# EasyEDA Pro project AgOopenHardwareMicro.eprj, schematic AiO v4 Micro Robin

## Sheets
1 Power: Create Date: 2024-03-27; Page Name: Power; Project Name: AgOopenHardwareMicro; Schematic Name: AiO v4 Micro Robin; Update Date: 2024-06-02; Company: EasyEDA.com; Drawn: EasyEDA; Page Size: A4; Part Number: JLCPCB-002; Reviewed: EasyEDA; Version: V0.1
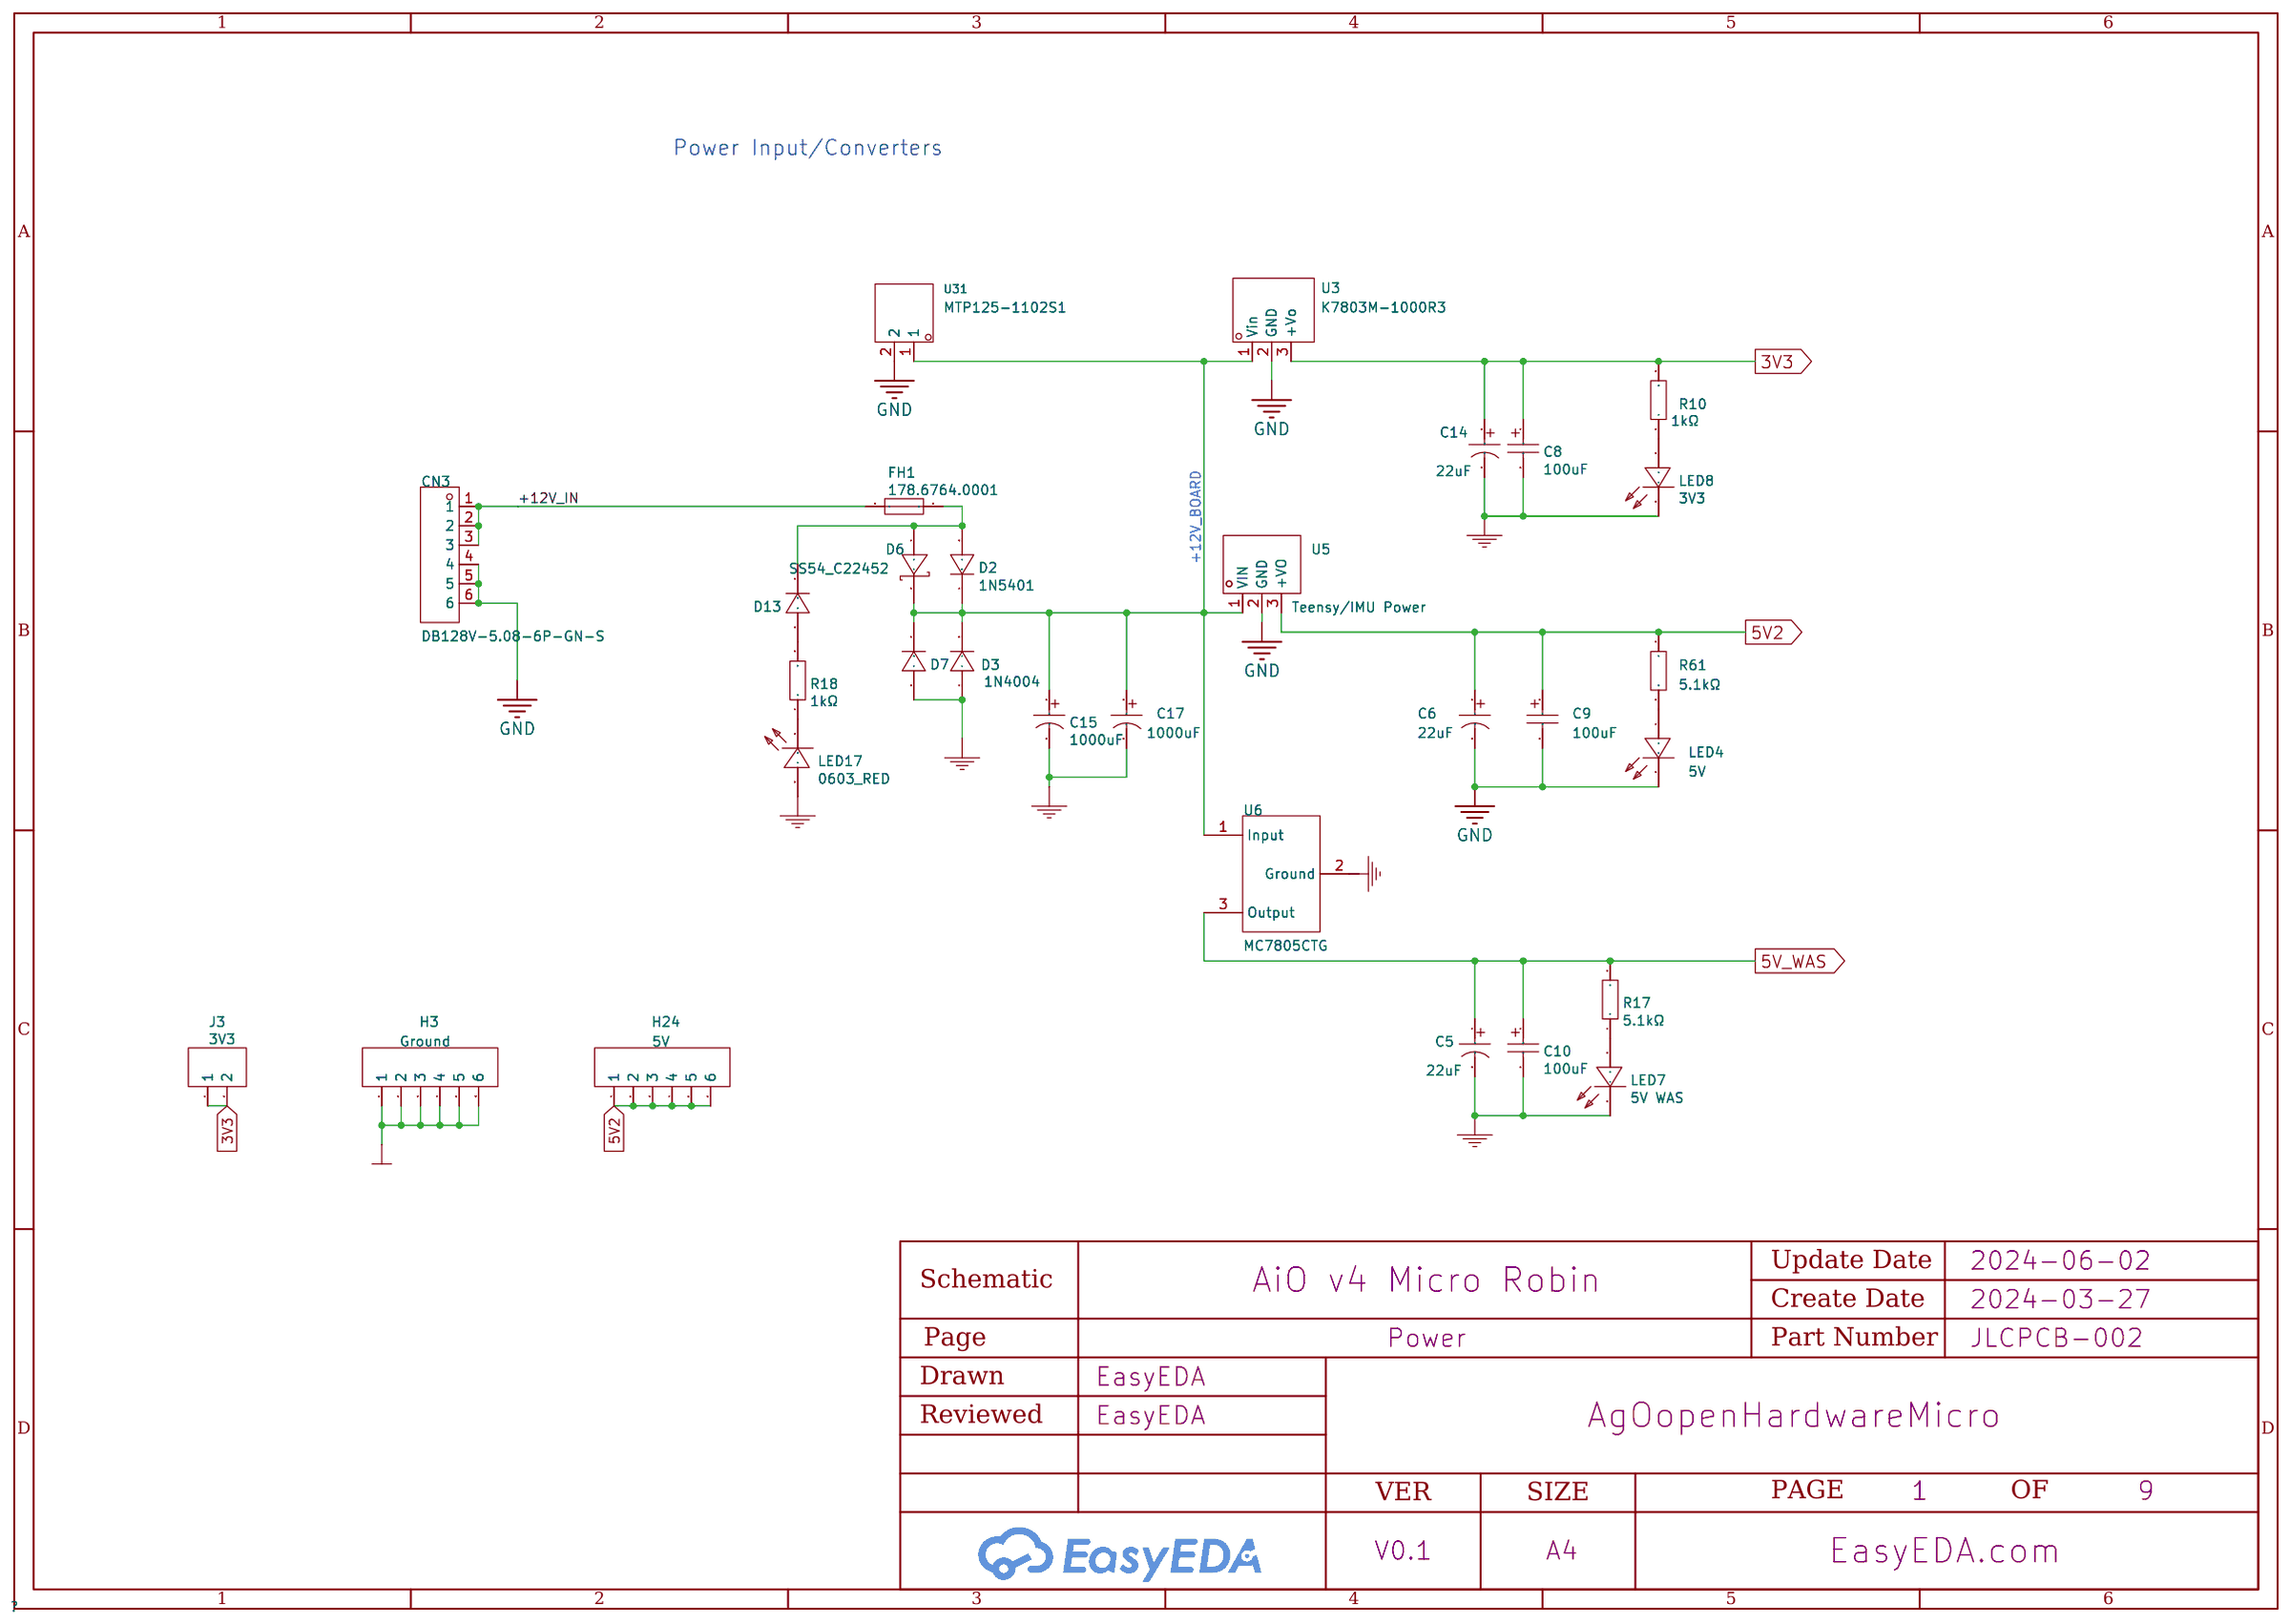
[diagram p1: Power]
2 WAS: Page Name: WAS; Update Date: 2024-04-04
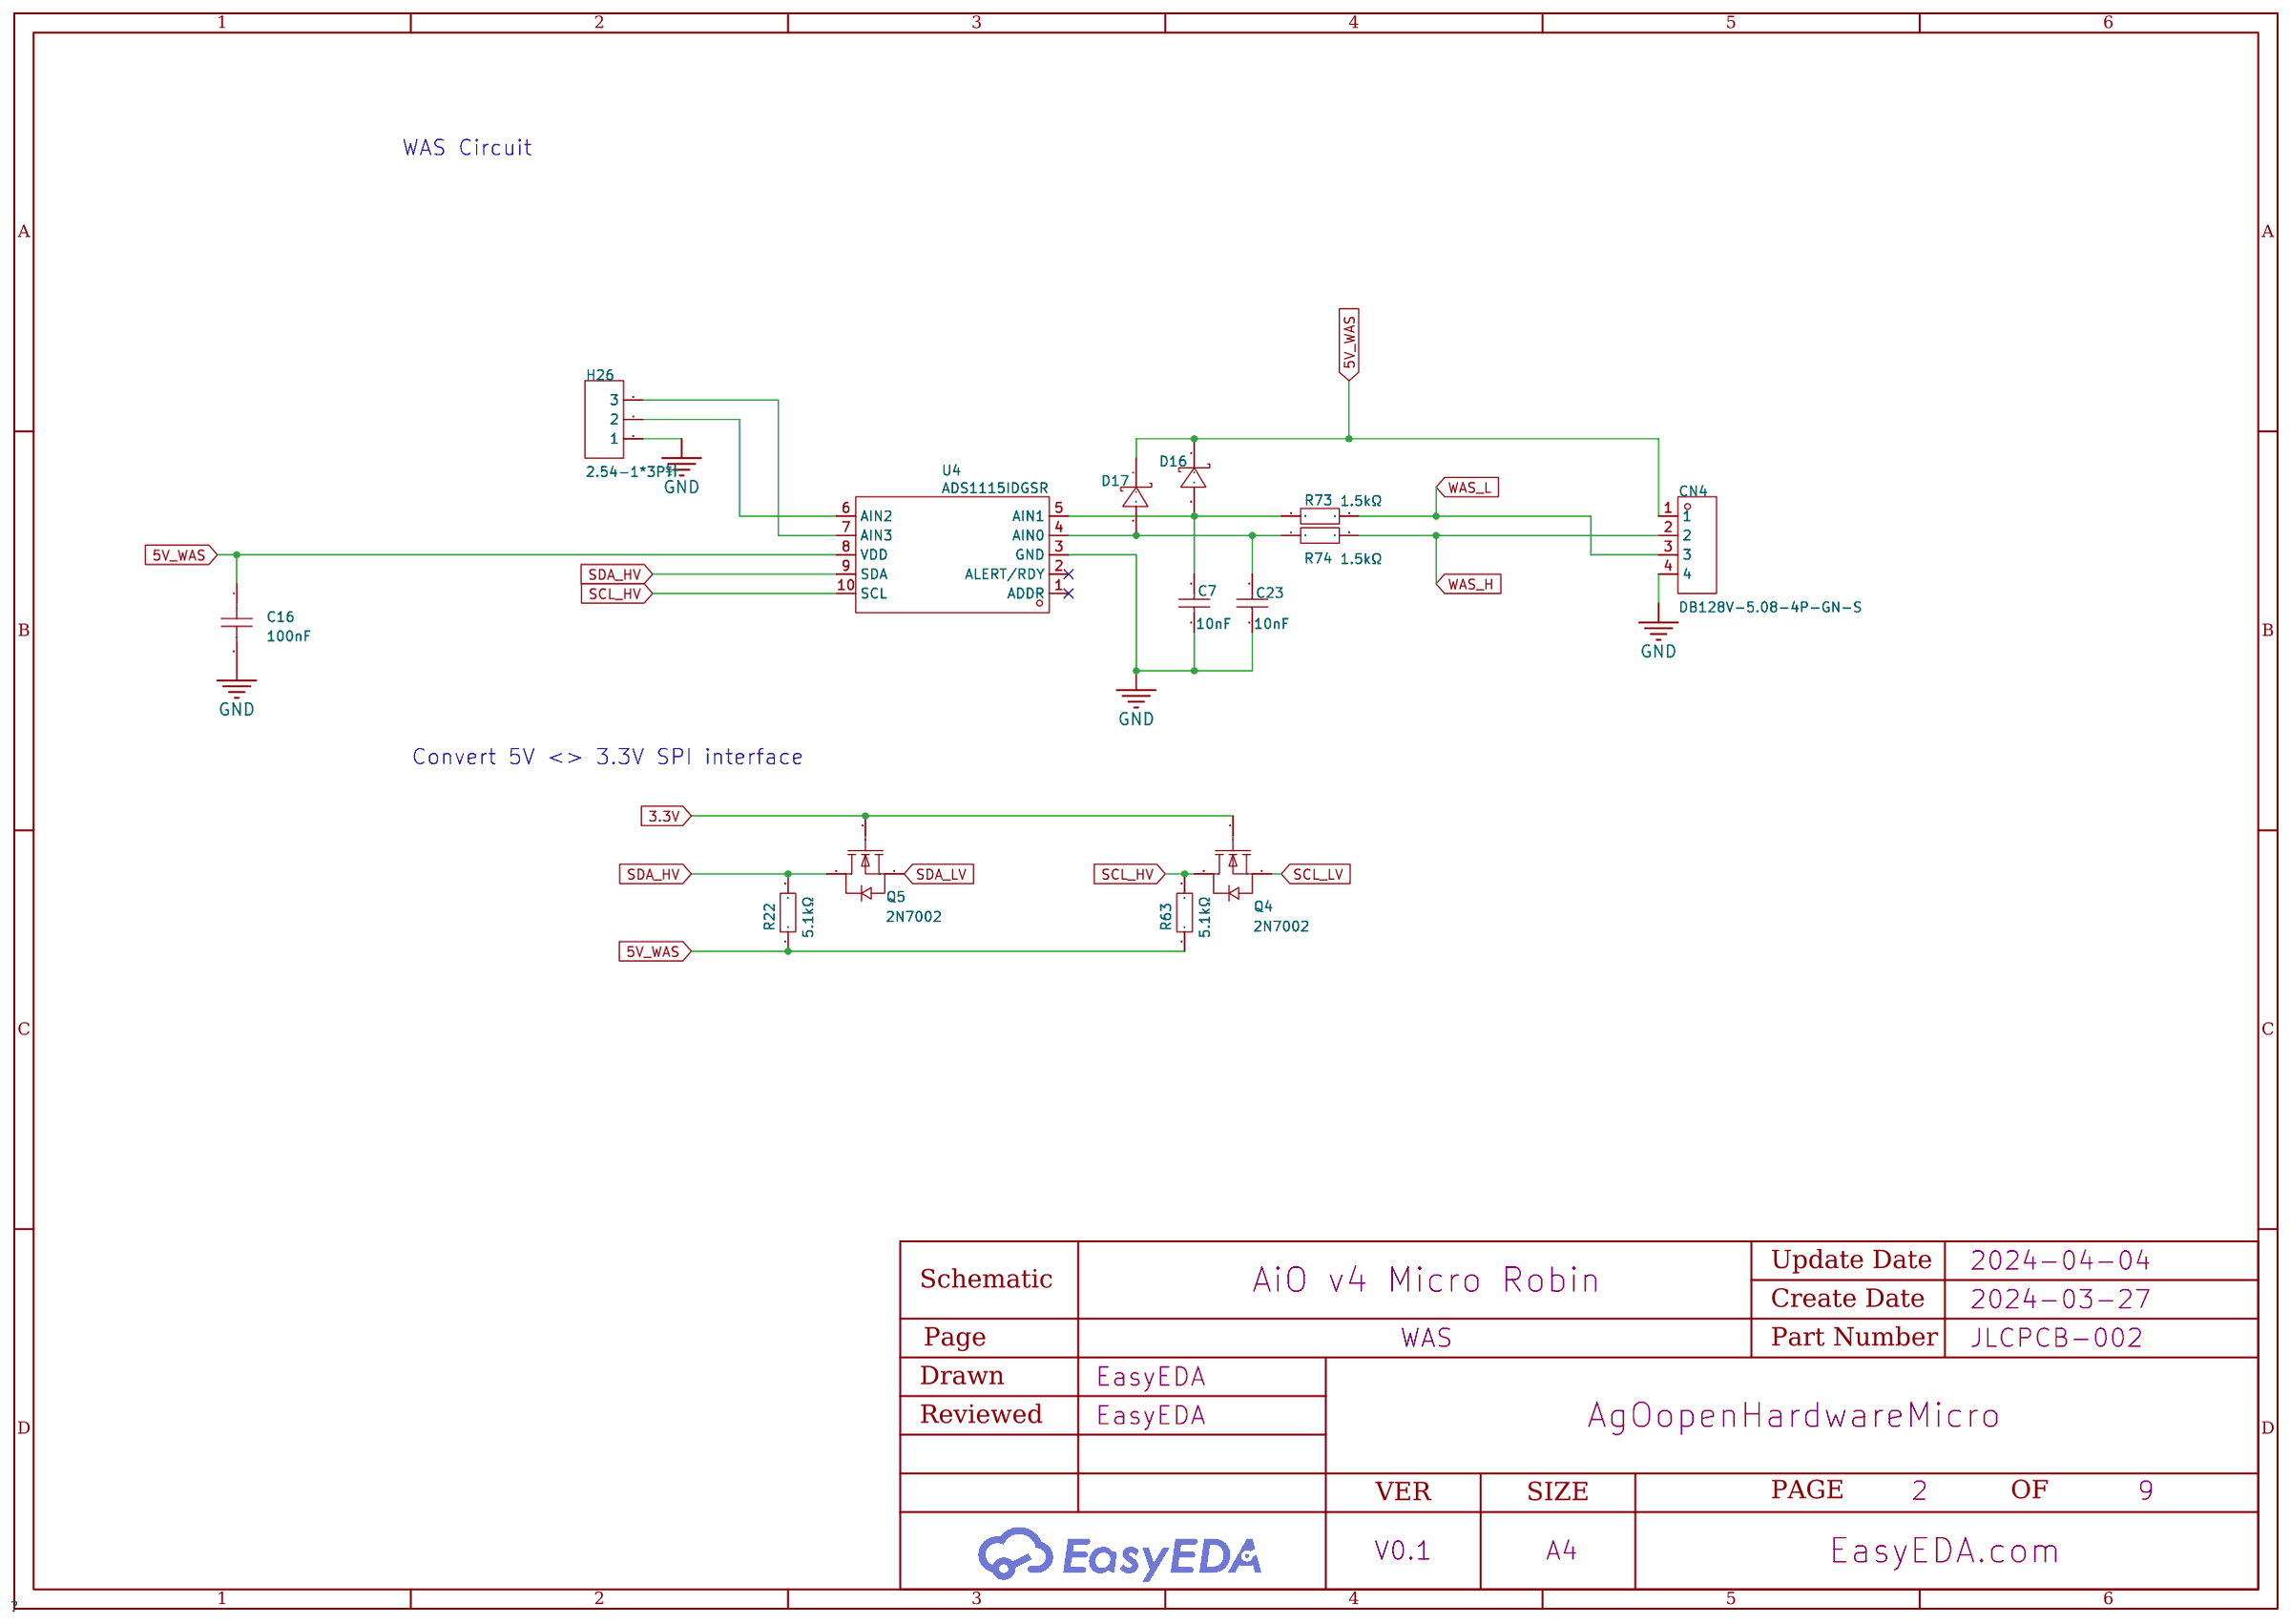
[diagram p2: WAS]
3 TeensyInputs: Page Name: TeensyInputs
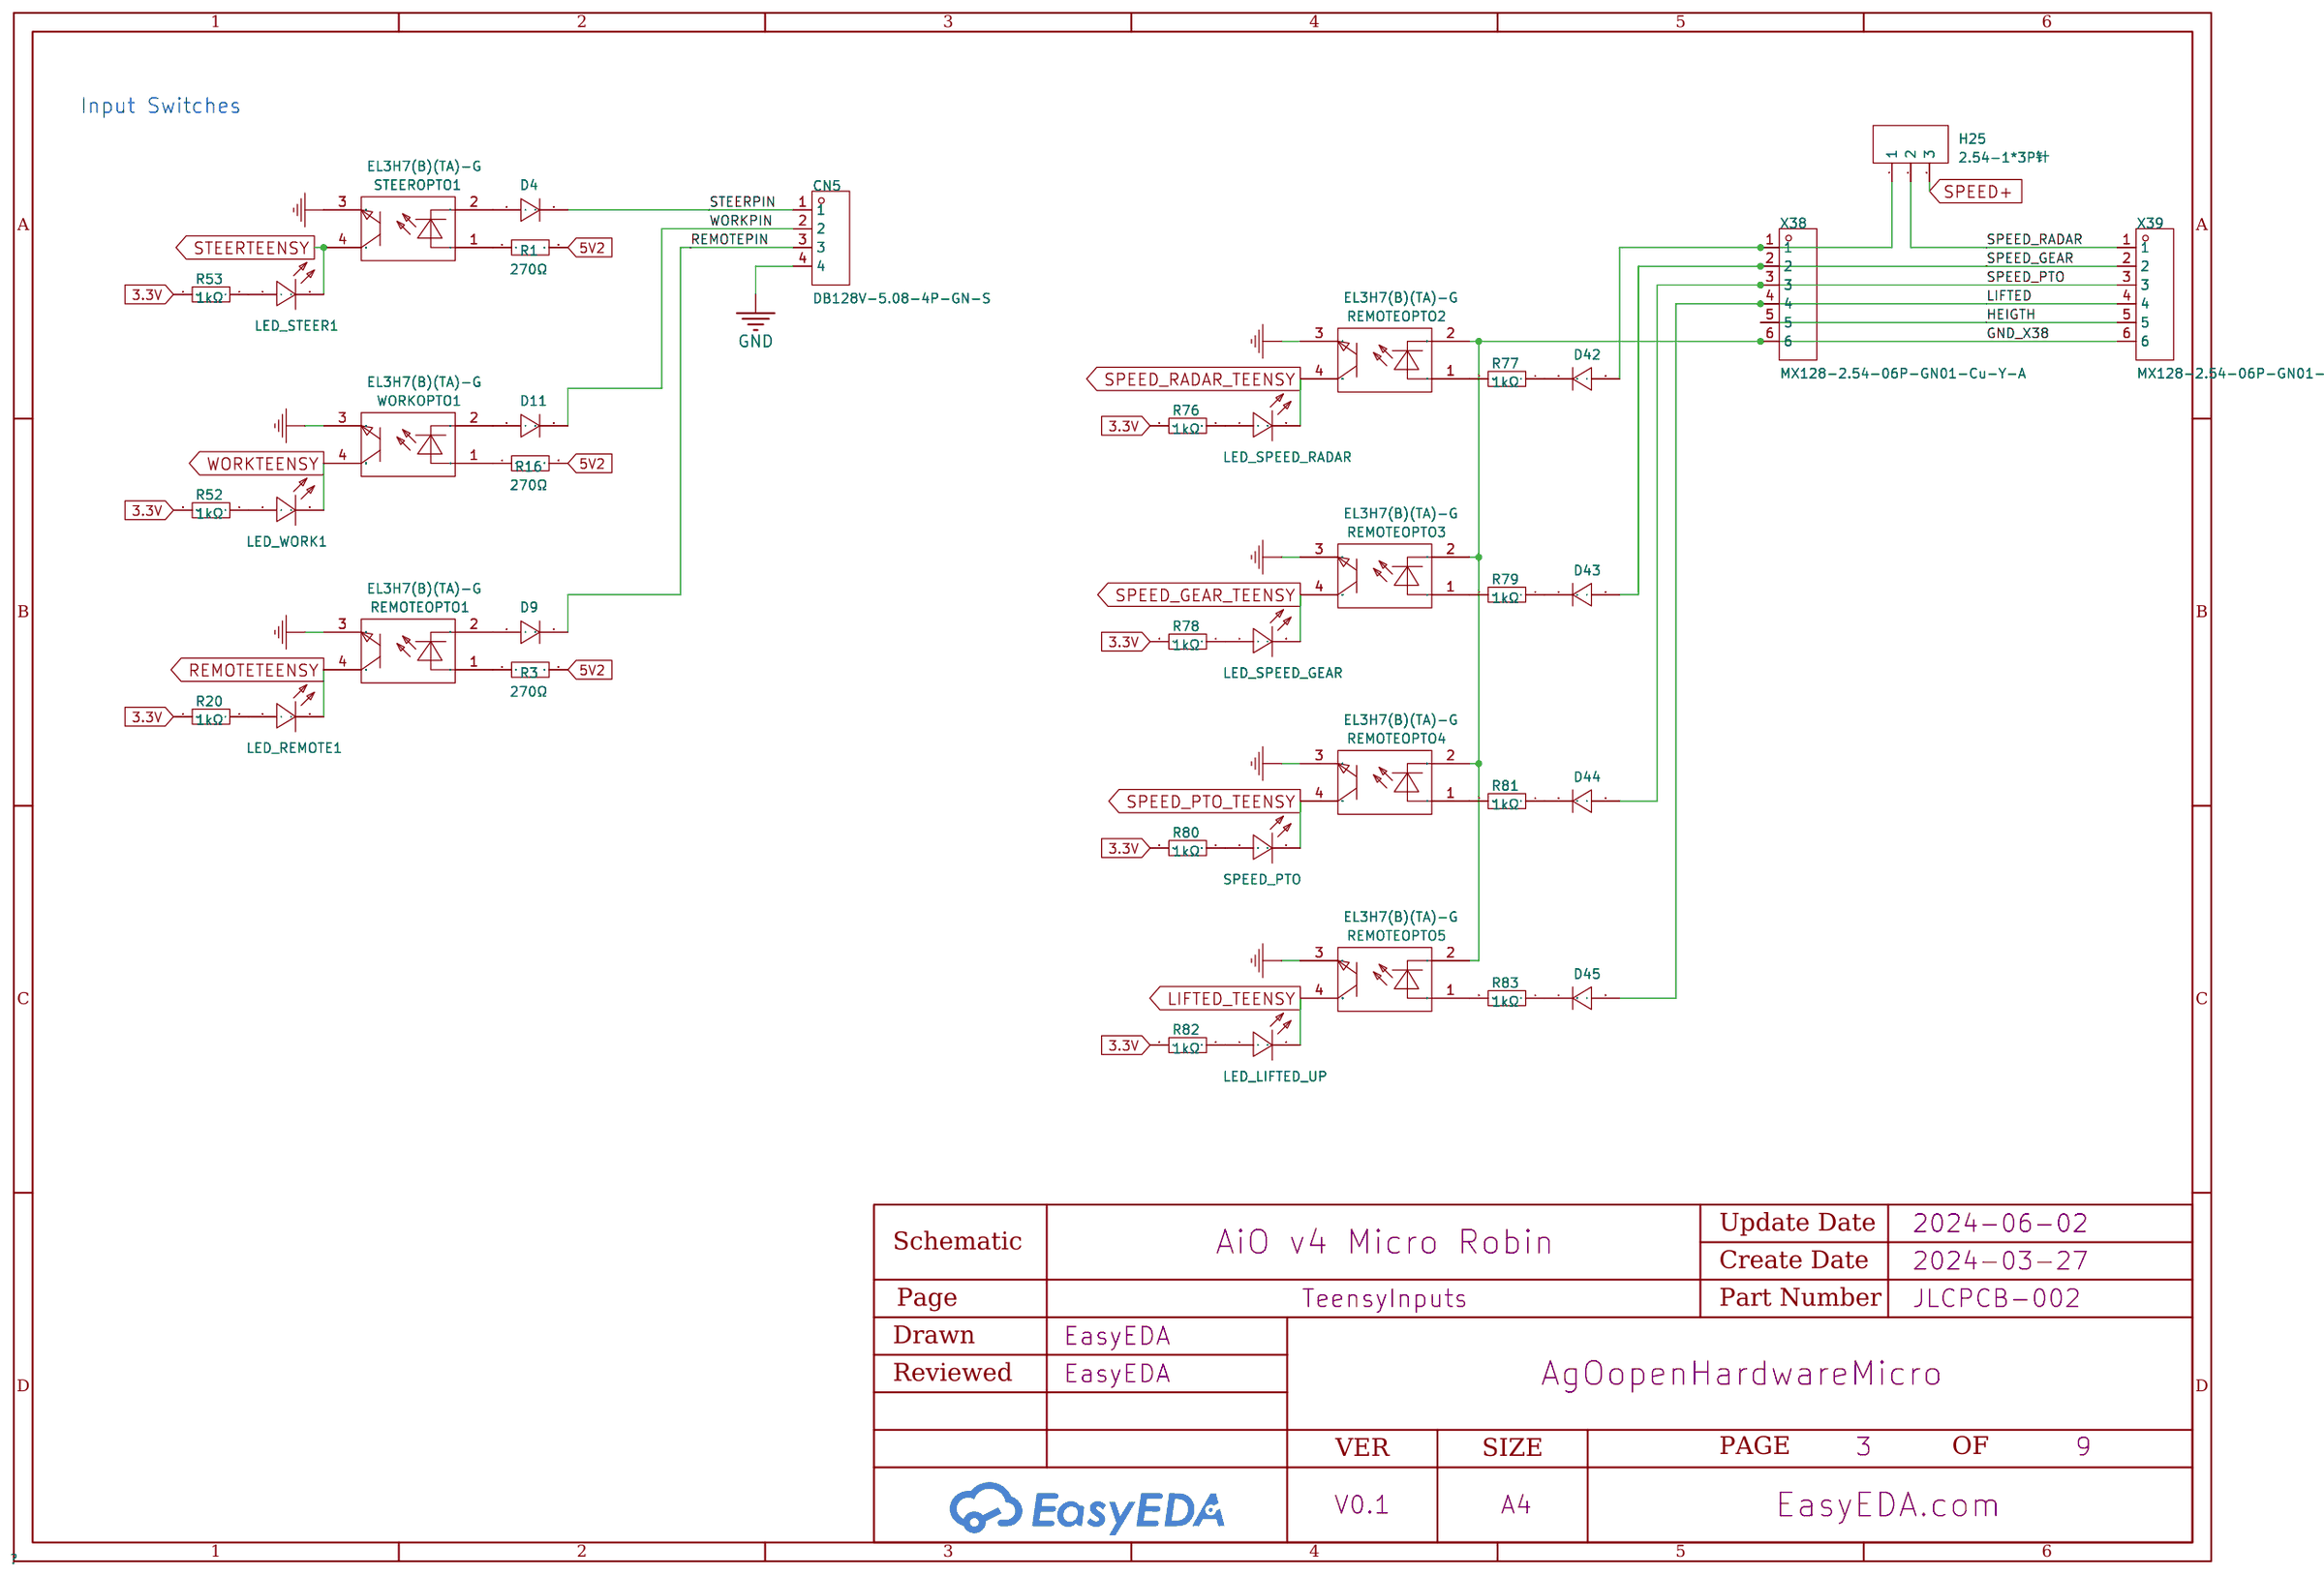
[diagram p3: TeensyInputs]
4 Teensy: Page Name: Teensy; Update Date: 2024-04-04
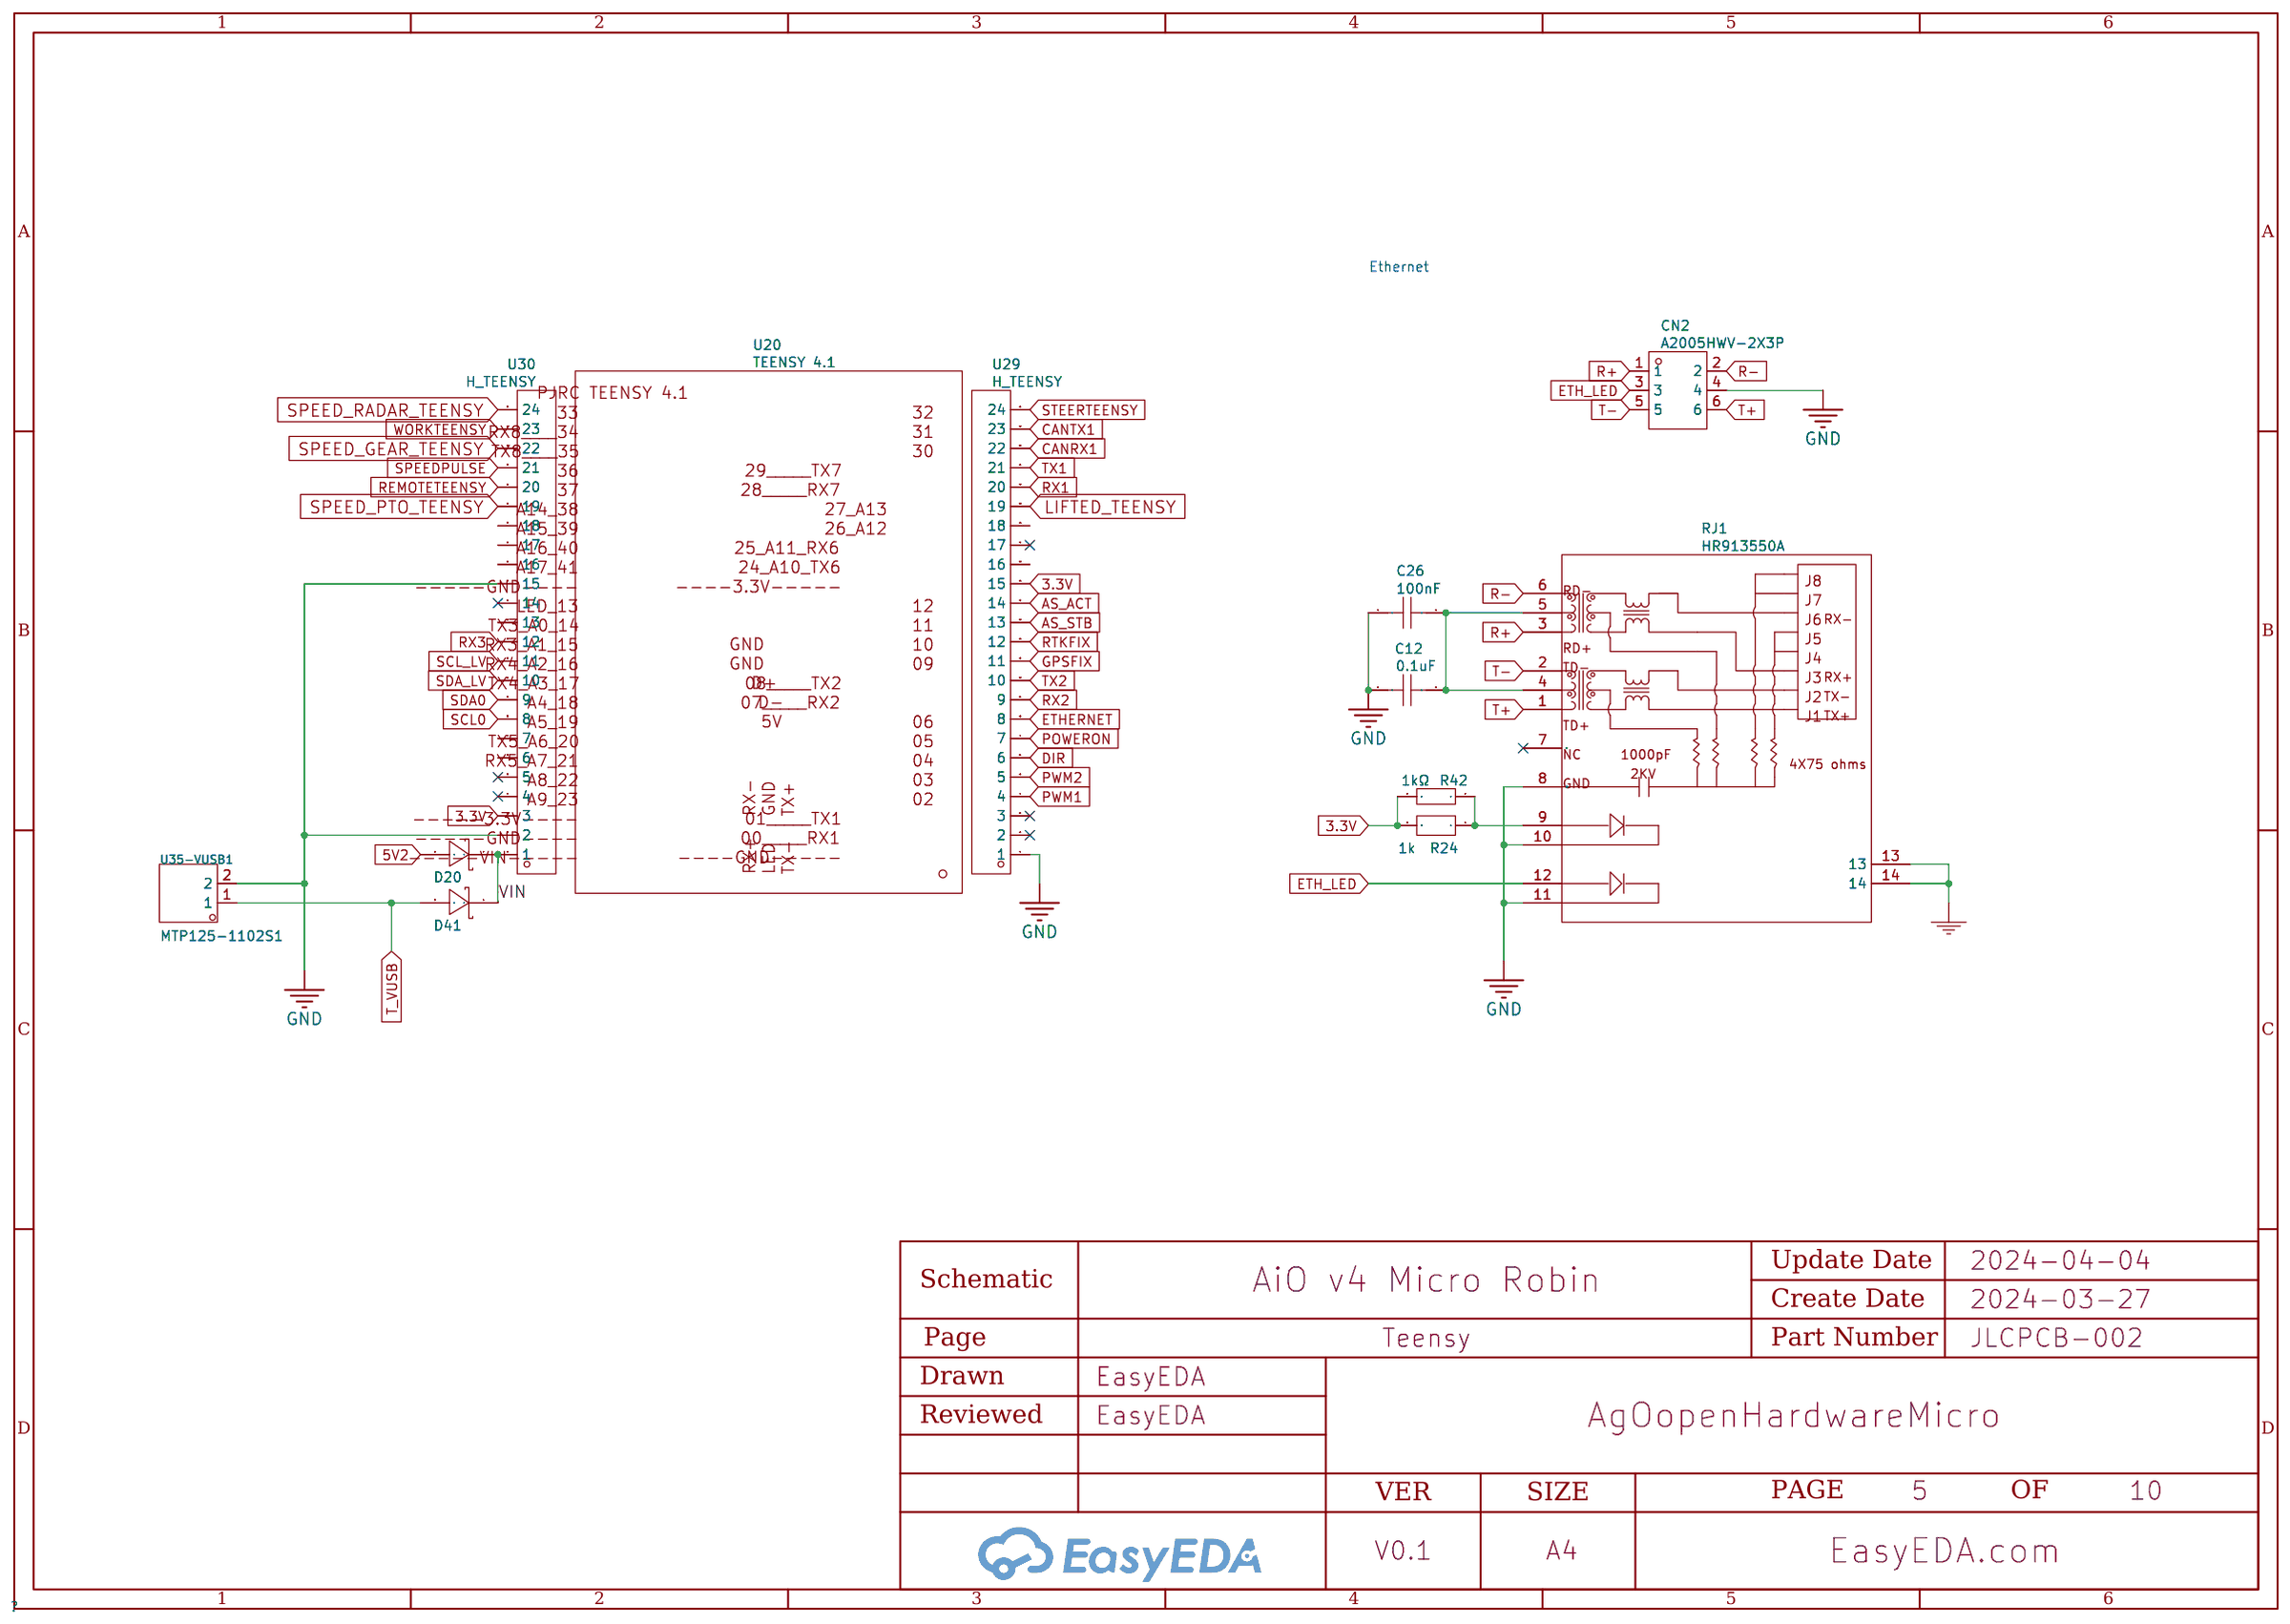
[diagram p4: Teensy]
5 TeensyStatusLED: Page Name: TeensyStatusLED; Update Date: 2024-03-28